# EAGLE board Resistor_Resistor (EAGLE 8.3.0), part 21 of 32
## Placement (x,y rotation side) (continued)
R25476  10K  [0201]  180.19,46.99 0 top
R25477  10K  [0201]  180.19,47.6 0 top
R25478  10K  [0201]  180.19,48.21 0 top
R25479  10K  [0201]  180.19,48.82 0 top
R25480  10K  [0201]  180.19,49.43 0 top
R25481  10K  [0201]  180.19,50.04 0 top
R25482  10K  [0201]  180.19,50.65 0 top
R25483  10K  [0201]  180.19,51.26 0 top
R25484  10K  [0201]  180.19,51.87 0 top
R25485  10K  [0201]  180.19,52.48 0 top
R25486  10K  [0201]  180.19,53.09 0 top
R25487  10K  [0201]  180.19,53.7 0 top
R25488  10K  [0201]  180.19,54.31 0 top
R25489  10K  [0201]  180.19,54.91 0 top
R25490  10K  [0201]  180.19,55.52 0 top
R25491  10K  [0201]  180.19,56.13 0 top
R25492  10K  [0201]  180.19,56.74 0 top
R25493  10K  [0201]  180.19,57.35 0 top
R25494  10K  [0201]  180.19,57.96 0 top
R25495  10K  [0201]  180.19,58.57 0 top
R25496  10K  [0201]  180.19,59.18 0 top
R25497  10K  [0201]  180.19,59.79 0 top
R25498  10K  [0201]  180.19,60.4 0 top
R25499  10K  [0201]  180.19,61.01 0 top
R25500  10K  [0201]  180.19,61.62 0 top
R25501  10K  [0201]  180.19,62.23 0 top
R25502  10K  [0201]  180.19,62.84 0 top
R25503  10K  [0201]  180.19,63.45 0 top
R25504  10K  [0201]  180.19,64.06 0 top
R25505  10K  [0201]  180.19,64.67 0 top
R25506  10K  [0201]  180.19,65.28 0 top
R25507  10K  [0201]  180.19,65.89 0 top
R25508  10K  [0201]  180.19,66.5 0 top
R25509  10K  [0201]  180.19,67.11 0 top
R25510  10K  [0201]  180.19,67.72 0 top
R25511  10K  [0201]  180.19,68.33 0 top
R25512  10K  [0201]  180.19,68.94 0 top
R25513  10K  [0201]  180.19,69.55 0 top
R25514  10K  [0201]  180.19,70.15 0 top
R25515  10K  [0201]  180.19,70.76 0 top
R25516  10K  [0201]  180.19,71.37 0 top
R25517  10K  [0201]  180.19,71.98 0 top
R25518  10K  [0201]  180.19,72.59 0 top
R25519  10K  [0201]  180.19,73.2 0 top
R25520  10K  [0201]  180.19,73.81 0 top
R25521  10K  [0201]  180.19,74.42 0 top
R25522  10K  [0201]  180.19,75.03 0 top
R25523  10K  [0201]  180.19,75.64 0 top
R25524  10K  [0201]  180.19,76.25 0 top
R25525  10K  [0201]  180.19,76.86 0 top
R25526  10K  [0201]  180.19,77.47 0 top
R25527  10K  [0201]  180.19,78.08 0 top
R25528  10K  [0201]  180.19,78.69 0 top
R25529  10K  [0201]  180.19,79.3 0 top
R25530  10K  [0201]  180.19,79.91 0 top
R25531  10K  [0201]  180.19,80.52 0 top
R25532  10K  [0201]  180.19,81.13 0 top
R25533  10K  [0201]  180.19,81.74 0 top
R25534  10K  [0201]  180.19,82.35 0 top
R25535  10K  [0201]  180.19,82.96 0 top
R25536  10K  [0201]  180.19,83.57 0 top
R25537  10K  [0201]  180.19,84.18 0 top
R25538  10K  [0201]  180.19,84.79 0 top
R25539  10K  [0201]  180.19,85.39 0 top
R25540  10K  [0201]  180.19,86 0 top
R25541  10K  [0201]  180.19,86.61 0 top
R25542  10K  [0201]  180.19,87.22 0 top
R25543  10K  [0201]  180.19,87.83 0 top
R25544  10K  [0201]  180.19,88.44 0 top
R25545  10K  [0201]  180.19,89.05 0 top
R25546  10K  [0201]  180.19,89.66 0 top
R25547  10K  [0201]  180.19,90.27 0 top
R25548  10K  [0201]  180.19,90.88 0 top
R25549  10K  [0201]  180.19,91.49 0 top
R25550  10K  [0201]  180.19,92.1 0 top
R25551  10K  [0201]  180.19,92.71 0 top
R25552  10K  [0201]  180.19,93.32 0 top
R25553  10K  [0201]  180.19,93.93 0 top
R25554  10K  [0201]  180.19,94.54 0 top
R25555  10K  [0201]  180.19,95.15 0 top
R25556  10K  [0201]  180.19,95.76 0 top
R25557  10K  [0201]  180.19,96.37 0 top
R25558  10K  [0201]  180.19,96.98 0 top
R25559  10K  [0201]  180.19,97.59 0 top
R25560  10K  [0201]  180.19,98.2 0 top
R25561  10K  [0201]  180.19,98.81 0 top
R25562  10K  [0201]  180.19,99.42 0 top
R25563  10K  [0201]  180.19,100.03 0 top
R25564  10K  [0201]  180.19,100.63 0 top
R25565  10K  [0201]  180.19,101.24 0 top
R25566  10K  [0201]  180.19,101.85 0 top
R25567  10K  [0201]  180.19,102.46 0 top
R25568  10K  [0201]  180.19,103.07 0 top
R25569  10K  [0201]  180.19,103.68 0 top
R25570  10K  [0201]  180.19,104.29 0 top
R25571  10K  [0201]  180.19,104.9 0 top
R25572  10K  [0201]  180.19,105.51 0 top
R25573  10K  [0201]  180.19,106.12 0 top
R25574  10K  [0201]  180.19,106.73 0 top
R25575  10K  [0201]  180.19,107.34 0 top
R25576  10K  [0201]  180.19,107.95 0 top
R25577  10K  [0201]  180.19,108.56 0 top
R25578  10K  [0201]  180.19,109.17 0 top
R25579  10K  [0201]  180.19,109.78 0 top
R25580  10K  [0201]  180.19,110.39 0 top
R25581  10K  [0201]  180.19,111 0 top
R25582  10K  [0201]  180.19,111.61 0 top
R25583  10K  [0201]  180.19,112.22 0 top
R25584  10K  [0201]  180.19,112.83 0 top
R25585  10K  [0201]  180.19,113.44 0 top
R25586  10K  [0201]  180.19,114.05 0 top
R25587  10K  [0201]  180.19,114.66 0 top
R25588  10K  [0201]  180.19,115.27 0 top
R25589  10K  [0201]  180.19,115.87 0 top
R25590  10K  [0201]  180.19,116.48 0 top
R25591  10K  [0201]  180.19,117.09 0 top
R25592  10K  [0201]  180.19,117.7 0 top
R25593  10K  [0201]  180.19,118.31 0 top
R25594  10K  [0201]  180.19,118.92 0 top
R25595  10K  [0201]  180.19,119.53 0 top
R25596  10K  [0201]  180.19,120.14 0 top
R25597  10K  [0201]  180.19,120.75 0 top
R25598  10K  [0201]  180.19,121.36 0 top
R25599  10K  [0201]  180.19,121.97 0 top
R25600  10K  [0201]  180.19,122.58 0 top
R25601  10K  [0201]  181.41,1.27 0 top
R25602  10K  [0201]  181.41,1.88 0 top
R25603  10K  [0201]  181.41,2.49 0 top
R25604  10K  [0201]  181.41,3.1 0 top
R25605  10K  [0201]  181.41,3.71 0 top
R25606  10K  [0201]  181.41,4.32 0 top
R25607  10K  [0201]  181.41,4.93 0 top
R25608  10K  [0201]  181.41,5.54 0 top
R25609  10K  [0201]  181.41,6.15 0 top
R25610  10K  [0201]  181.41,6.76 0 top
R25611  10K  [0201]  181.41,7.37 0 top
R25612  10K  [0201]  181.41,7.98 0 top
R25613  10K  [0201]  181.41,8.59 0 top
R25614  10K  [0201]  181.41,9.19 0 top
R25615  10K  [0201]  181.41,9.8 0 top
R25616  10K  [0201]  181.41,10.41 0 top
R25617  10K  [0201]  181.41,11.02 0 top
R25618  10K  [0201]  181.41,11.63 0 top
R25619  10K  [0201]  181.41,12.24 0 top
R25620  10K  [0201]  181.41,12.85 0 top
R25621  10K  [0201]  181.41,13.46 0 top
R25622  10K  [0201]  181.41,14.07 0 top
R25623  10K  [0201]  181.41,14.68 0 top
R25624  10K  [0201]  181.41,15.29 0 top
R25625  10K  [0201]  181.41,15.9 0 top
R25626  10K  [0201]  181.41,16.51 0 top
R25627  10K  [0201]  181.41,17.12 0 top
R25628  10K  [0201]  181.41,17.73 0 top
R25629  10K  [0201]  181.41,18.34 0 top
R25630  10K  [0201]  181.41,18.95 0 top
R25631  10K  [0201]  181.41,19.56 0 top
R25632  10K  [0201]  181.41,20.17 0 top
R25633  10K  [0201]  181.41,20.78 0 top
R25634  10K  [0201]  181.41,21.39 0 top
R25635  10K  [0201]  181.41,22 0 top
R25636  10K  [0201]  181.41,22.61 0 top
R25637  10K  [0201]  181.41,23.22 0 top
R25638  10K  [0201]  181.41,23.83 0 top
R25639  10K  [0201]  181.41,24.43 0 top
R25640  10K  [0201]  181.41,25.04 0 top
R25641  10K  [0201]  181.41,25.65 0 top
R25642  10K  [0201]  181.41,26.26 0 top
R25643  10K  [0201]  181.41,26.87 0 top
R25644  10K  [0201]  181.41,27.48 0 top
R25645  10K  [0201]  181.41,28.09 0 top
R25646  10K  [0201]  181.41,28.7 0 top
R25647  10K  [0201]  181.41,29.31 0 top
R25648  10K  [0201]  181.41,29.92 0 top
R25649  10K  [0201]  181.41,30.53 0 top
R25650  10K  [0201]  181.41,31.14 0 top
R25651  10K  [0201]  181.41,31.75 0 top
R25652  10K  [0201]  181.41,32.36 0 top
R25653  10K  [0201]  181.41,32.97 0 top
R25654  10K  [0201]  181.41,33.58 0 top
R25655  10K  [0201]  181.41,34.19 0 top
R25656  10K  [0201]  181.41,34.8 0 top
R25657  10K  [0201]  181.41,35.41 0 top
R25658  10K  [0201]  181.41,36.02 0 top
R25659  10K  [0201]  181.41,36.63 0 top
R25660  10K  [0201]  181.41,37.24 0 top
R25661  10K  [0201]  181.41,37.85 0 top
R25662  10K  [0201]  181.41,38.46 0 top
R25663  10K  [0201]  181.41,39.07 0 top
R25664  10K  [0201]  181.41,39.67 0 top
R25665  10K  [0201]  181.41,40.28 0 top
R25666  10K  [0201]  181.41,40.89 0 top
R25667  10K  [0201]  181.41,41.5 0 top
R25668  10K  [0201]  181.41,42.11 0 top
R25669  10K  [0201]  181.41,42.72 0 top
R25670  10K  [0201]  181.41,43.33 0 top
R25671  10K  [0201]  181.41,43.94 0 top
R25672  10K  [0201]  181.41,44.55 0 top
R25673  10K  [0201]  181.41,45.16 0 top
R25674  10K  [0201]  181.41,45.77 0 top
R25675  10K  [0201]  181.41,46.38 0 top
R25676  10K  [0201]  181.41,46.99 0 top
R25677  10K  [0201]  181.41,47.6 0 top
R25678  10K  [0201]  181.41,48.21 0 top
R25679  10K  [0201]  181.41,48.82 0 top
R25680  10K  [0201]  181.41,49.43 0 top
R25681  10K  [0201]  181.41,50.04 0 top
R25682  10K  [0201]  181.41,50.65 0 top
R25683  10K  [0201]  181.41,51.26 0 top
R25684  10K  [0201]  181.41,51.87 0 top
R25685  10K  [0201]  181.41,52.48 0 top
R25686  10K  [0201]  181.41,53.09 0 top
R25687  10K  [0201]  181.41,53.7 0 top
R25688  10K  [0201]  181.41,54.31 0 top
R25689  10K  [0201]  181.41,54.91 0 top
R25690  10K  [0201]  181.41,55.52 0 top
R25691  10K  [0201]  181.41,56.13 0 top
R25692  10K  [0201]  181.41,56.74 0 top
R25693  10K  [0201]  181.41,57.35 0 top
R25694  10K  [0201]  181.41,57.96 0 top
R25695  10K  [0201]  181.41,58.57 0 top
R25696  10K  [0201]  181.41,59.18 0 top
R25697  10K  [0201]  181.41,59.79 0 top
R25698  10K  [0201]  181.41,60.4 0 top
R25699  10K  [0201]  181.41,61.01 0 top
R25700  10K  [0201]  181.41,61.62 0 top
R25701  10K  [0201]  181.41,62.23 0 top
R25702  10K  [0201]  181.41,62.84 0 top
R25703  10K  [0201]  181.41,63.45 0 top
R25704  10K  [0201]  181.41,64.06 0 top
R25705  10K  [0201]  181.41,64.67 0 top
R25706  10K  [0201]  181.41,65.28 0 top
R25707  10K  [0201]  181.41,65.89 0 top
R25708  10K  [0201]  181.41,66.5 0 top
R25709  10K  [0201]  181.41,67.11 0 top
R25710  10K  [0201]  181.41,67.72 0 top
R25711  10K  [0201]  181.41,68.33 0 top
R25712  10K  [0201]  181.41,68.94 0 top
R25713  10K  [0201]  181.41,69.55 0 top
R25714  10K  [0201]  181.41,70.15 0 top
R25715  10K  [0201]  181.41,70.76 0 top
R25716  10K  [0201]  181.41,71.37 0 top
R25717  10K  [0201]  181.41,71.98 0 top
R25718  10K  [0201]  181.41,72.59 0 top
R25719  10K  [0201]  181.41,73.2 0 top
R25720  10K  [0201]  181.41,73.81 0 top
R25721  10K  [0201]  181.41,74.42 0 top
R25722  10K  [0201]  181.41,75.03 0 top
R25723  10K  [0201]  181.41,75.64 0 top
R25724  10K  [0201]  181.41,76.25 0 top
R25725  10K  [0201]  181.41,76.86 0 top
R25726  10K  [0201]  181.41,77.47 0 top
R25727  10K  [0201]  181.41,78.08 0 top
R25728  10K  [0201]  181.41,78.69 0 top
R25729  10K  [0201]  181.41,79.3 0 top
R25730  10K  [0201]  181.41,79.91 0 top
R25731  10K  [0201]  181.41,80.52 0 top
R25732  10K  [0201]  181.41,81.13 0 top
R25733  10K  [0201]  181.41,81.74 0 top
R25734  10K  [0201]  181.41,82.35 0 top
R25735  10K  [0201]  181.41,82.96 0 top
R25736  10K  [0201]  181.41,83.57 0 top
R25737  10K  [0201]  181.41,84.18 0 top
R25738  10K  [0201]  181.41,84.79 0 top
R25739  10K  [0201]  181.41,85.39 0 top
R25740  10K  [0201]  181.41,86 0 top
R25741  10K  [0201]  181.41,86.61 0 top
R25742  10K  [0201]  181.41,87.22 0 top
R25743  10K  [0201]  181.41,87.83 0 top
R25744  10K  [0201]  181.41,88.44 0 top
R25745  10K  [0201]  181.41,89.05 0 top
R25746  10K  [0201]  181.41,89.66 0 top
R25747  10K  [0201]  181.41,90.27 0 top
R25748  10K  [0201]  181.41,90.88 0 top
R25749  10K  [0201]  181.41,91.49 0 top
R25750  10K  [0201]  181.41,92.1 0 top
R25751  10K  [0201]  181.41,92.71 0 top
R25752  10K  [0201]  181.41,93.32 0 top
R25753  10K  [0201]  181.41,93.93 0 top
R25754  10K  [0201]  181.41,94.54 0 top
R25755  10K  [0201]  181.41,95.15 0 top
R25756  10K  [0201]  181.41,95.76 0 top
R25757  10K  [0201]  181.41,96.37 0 top
R25758  10K  [0201]  181.41,96.98 0 top
R25759  10K  [0201]  181.41,97.59 0 top
R25760  10K  [0201]  181.41,98.2 0 top
R25761  10K  [0201]  181.41,98.81 0 top
R25762  10K  [0201]  181.41,99.42 0 top
R25763  10K  [0201]  181.41,100.03 0 top
R25764  10K  [0201]  181.41,100.63 0 top
R25765  10K  [0201]  181.41,101.24 0 top
R25766  10K  [0201]  181.41,101.85 0 top
R25767  10K  [0201]  181.41,102.46 0 top
R25768  10K  [0201]  181.41,103.07 0 top
R25769  10K  [0201]  181.41,103.68 0 top
R25770  10K  [0201]  181.41,104.29 0 top
R25771  10K  [0201]  181.41,104.9 0 top
R25772  10K  [0201]  181.41,105.51 0 top
R25773  10K  [0201]  181.41,106.12 0 top
R25774  10K  [0201]  181.41,106.73 0 top
R25775  10K  [0201]  181.41,107.34 0 top
R25776  10K  [0201]  181.41,107.95 0 top
R25777  10K  [0201]  181.41,108.56 0 top
R25778  10K  [0201]  181.41,109.17 0 top
R25779  10K  [0201]  181.41,109.78 0 top
R25780  10K  [0201]  181.41,110.39 0 top
R25781  10K  [0201]  181.41,111 0 top
R25782  10K  [0201]  181.41,111.61 0 top
R25783  10K  [0201]  181.41,112.22 0 top
R25784  10K  [0201]  181.41,112.83 0 top
R25785  10K  [0201]  181.41,113.44 0 top
R25786  10K  [0201]  181.41,114.05 0 top
R25787  10K  [0201]  181.41,114.66 0 top
R25788  10K  [0201]  181.41,115.27 0 top
R25789  10K  [0201]  181.41,115.87 0 top
R25790  10K  [0201]  181.41,116.48 0 top
R25791  10K  [0201]  181.41,117.09 0 top
R25792  10K  [0201]  181.41,117.7 0 top
R25793  10K  [0201]  181.41,118.31 0 top
R25794  10K  [0201]  181.41,118.92 0 top
R25795  10K  [0201]  181.41,119.53 0 top
R25796  10K  [0201]  181.41,120.14 0 top
R25797  10K  [0201]  181.41,120.75 0 top
R25798  10K  [0201]  181.41,121.36 0 top
R25799  10K  [0201]  181.41,121.97 0 top
R25800  10K  [0201]  181.41,122.58 0 top
R25801  10K  [0201]  182.63,1.27 0 top
R25802  10K  [0201]  182.63,1.88 0 top
R25803  10K  [0201]  182.63,2.49 0 top
R25804  10K  [0201]  182.63,3.1 0 top
R25805  10K  [0201]  182.63,3.71 0 top
R25806  10K  [0201]  182.63,4.32 0 top
R25807  10K  [0201]  182.63,4.93 0 top
R25808  10K  [0201]  182.63,5.54 0 top
R25809  10K  [0201]  182.63,6.15 0 top
R25810  10K  [0201]  182.63,6.76 0 top
R25811  10K  [0201]  182.63,7.37 0 top
R25812  10K  [0201]  182.63,7.98 0 top
R25813  10K  [0201]  182.63,8.59 0 top
R25814  10K  [0201]  182.63,9.19 0 top
R25815  10K  [0201]  182.63,9.8 0 top
R25816  10K  [0201]  182.63,10.41 0 top
R25817  10K  [0201]  182.63,11.02 0 top
R25818  10K  [0201]  182.63,11.63 0 top
R25819  10K  [0201]  182.63,12.24 0 top
R25820  10K  [0201]  182.63,12.85 0 top
R25821  10K  [0201]  182.63,13.46 0 top
R25822  10K  [0201]  182.63,14.07 0 top
R25823  10K  [0201]  182.63,14.68 0 top
R25824  10K  [0201]  182.63,15.29 0 top
R25825  10K  [0201]  182.63,15.9 0 top
R25826  10K  [0201]  182.63,16.51 0 top
R25827  10K  [0201]  182.63,17.12 0 top
R25828  10K  [0201]  182.63,17.73 0 top
R25829  10K  [0201]  182.63,18.34 0 top
R25830  10K  [0201]  182.63,18.95 0 top
R25831  10K  [0201]  182.63,19.56 0 top
R25832  10K  [0201]  182.63,20.17 0 top
R25833  10K  [0201]  182.63,20.78 0 top
R25834  10K  [0201]  182.63,21.39 0 top
R25835  10K  [0201]  182.63,22 0 top
R25836  10K  [0201]  182.63,22.61 0 top
R25837  10K  [0201]  182.63,23.22 0 top
R25838  10K  [0201]  182.63,23.83 0 top
R25839  10K  [0201]  182.63,24.43 0 top
R25840  10K  [0201]  182.63,25.04 0 top
R25841  10K  [0201]  182.63,25.65 0 top
R25842  10K  [0201]  182.63,26.26 0 top
R25843  10K  [0201]  182.63,26.87 0 top
R25844  10K  [0201]  182.63,27.48 0 top
R25845  10K  [0201]  182.63,28.09 0 top
R25846  10K  [0201]  182.63,28.7 0 top
R25847  10K  [0201]  182.63,29.31 0 top
R25848  10K  [0201]  182.63,29.92 0 top
R25849  10K  [0201]  182.63,30.53 0 top
R25850  10K  [0201]  182.63,31.14 0 top
R25851  10K  [0201]  182.63,31.75 0 top
R25852  10K  [0201]  182.63,32.36 0 top
R25853  10K  [0201]  182.63,32.97 0 top
R25854  10K  [0201]  182.63,33.58 0 top
R25855  10K  [0201]  182.63,34.19 0 top
R25856  10K  [0201]  182.63,34.8 0 top
R25857  10K  [0201]  182.63,35.41 0 top
R25858  10K  [0201]  182.63,36.02 0 top
R25859  10K  [0201]  182.63,36.63 0 top
R25860  10K  [0201]  182.63,37.24 0 top
R25861  10K  [0201]  182.63,37.85 0 top
R25862  10K  [0201]  182.63,38.46 0 top
R25863  10K  [0201]  182.63,39.07 0 top
R25864  10K  [0201]  182.63,39.67 0 top
R25865  10K  [0201]  182.63,40.28 0 top
R25866  10K  [0201]  182.63,40.89 0 top
R25867  10K  [0201]  182.63,41.5 0 top
R25868  10K  [0201]  182.63,42.11 0 top
R25869  10K  [0201]  182.63,42.72 0 top
R25870  10K  [0201]  182.63,43.33 0 top
R25871  10K  [0201]  182.63,43.94 0 top
R25872  10K  [0201]  182.63,44.55 0 top
R25873  10K  [0201]  182.63,45.16 0 top
R25874  10K  [0201]  182.63,45.77 0 top
R25875  10K  [0201]  182.63,46.38 0 top
R25876  10K  [0201]  182.63,46.99 0 top
R25877  10K  [0201]  182.63,47.6 0 top
R25878  10K  [0201]  182.63,48.21 0 top
R25879  10K  [0201]  182.63,48.82 0 top
R25880  10K  [0201]  182.63,49.43 0 top
R25881  10K  [0201]  182.63,50.04 0 top
R25882  10K  [0201]  182.63,50.65 0 top
R25883  10K  [0201]  182.63,51.26 0 top
R25884  10K  [0201]  182.63,51.87 0 top
R25885  10K  [0201]  182.63,52.48 0 top
R25886  10K  [0201]  182.63,53.09 0 top
R25887  10K  [0201]  182.63,53.7 0 top
R25888  10K  [0201]  182.63,54.31 0 top
R25889  10K  [0201]  182.63,54.91 0 top
R25890  10K  [0201]  182.63,55.52 0 top
R25891  10K  [0201]  182.63,56.13 0 top
R25892  10K  [0201]  182.63,56.74 0 top
R25893  10K  [0201]  182.63,57.35 0 top
R25894  10K  [0201]  182.63,57.96 0 top
R25895  10K  [0201]  182.63,58.57 0 top
R25896  10K  [0201]  182.63,59.18 0 top
R25897  10K  [0201]  182.63,59.79 0 top
R25898  10K  [0201]  182.63,60.4 0 top
R25899  10K  [0201]  182.63,61.01 0 top
R25900  10K  [0201]  182.63,61.62 0 top
R25901  10K  [0201]  182.63,62.23 0 top
R25902  10K  [0201]  182.63,62.84 0 top
R25903  10K  [0201]  182.63,63.45 0 top
R25904  10K  [0201]  182.63,64.06 0 top
R25905  10K  [0201]  182.63,64.67 0 top
R25906  10K  [0201]  182.63,65.28 0 top
R25907  10K  [0201]  182.63,65.89 0 top
R25908  10K  [0201]  182.63,66.5 0 top
R25909  10K  [0201]  182.63,67.11 0 top
R25910  10K  [0201]  182.63,67.72 0 top
R25911  10K  [0201]  182.63,68.33 0 top
R25912  10K  [0201]  182.63,68.94 0 top
R25913  10K  [0201]  182.63,69.55 0 top
R25914  10K  [0201]  182.63,70.15 0 top
R25915  10K  [0201]  182.63,70.76 0 top
R25916  10K  [0201]  182.63,71.37 0 top
R25917  10K  [0201]  182.63,71.98 0 top
R25918  10K  [0201]  182.63,72.59 0 top
R25919  10K  [0201]  182.63,73.2 0 top
R25920  10K  [0201]  182.63,73.81 0 top
R25921  10K  [0201]  182.63,74.42 0 top
R25922  10K  [0201]  182.63,75.03 0 top
R25923  10K  [0201]  182.63,75.64 0 top
R25924  10K  [0201]  182.63,76.25 0 top
R25925  10K  [0201]  182.63,76.86 0 top
R25926  10K  [0201]  182.63,77.47 0 top
R25927  10K  [0201]  182.63,78.08 0 top
R25928  10K  [0201]  182.63,78.69 0 top
R25929  10K  [0201]  182.63,79.3 0 top
R25930  10K  [0201]  182.63,79.91 0 top
R25931  10K  [0201]  182.63,80.52 0 top
R25932  10K  [0201]  182.63,81.13 0 top
R25933  10K  [0201]  182.63,81.74 0 top
R25934  10K  [0201]  182.63,82.35 0 top
R25935  10K  [0201]  182.63,82.96 0 top
R25936  10K  [0201]  182.63,83.57 0 top
R25937  10K  [0201]  182.63,84.18 0 top
R25938  10K  [0201]  182.63,84.79 0 top
R25939  10K  [0201]  182.63,85.39 0 top
R25940  10K  [0201]  182.63,86 0 top
R25941  10K  [0201]  182.63,86.61 0 top
R25942  10K  [0201]  182.63,87.22 0 top
R25943  10K  [0201]  182.63,87.83 0 top
R25944  10K  [0201]  182.63,88.44 0 top
R25945  10K  [0201]  182.63,89.05 0 top
R25946  10K  [0201]  182.63,89.66 0 top
R25947  10K  [0201]  182.63,90.27 0 top
R25948  10K  [0201]  182.63,90.88 0 top
R25949  10K  [0201]  182.63,91.49 0 top
R25950  10K  [0201]  182.63,92.1 0 top
R25951  10K  [0201]  182.63,92.71 0 top
R25952  10K  [0201]  182.63,93.32 0 top
R25953  10K  [0201]  182.63,93.93 0 top
R25954  10K  [0201]  182.63,94.54 0 top
R25955  10K  [0201]  182.63,95.15 0 top
R25956  10K  [0201]  182.63,95.76 0 top
R25957  10K  [0201]  182.63,96.37 0 top
R25958  10K  [0201]  182.63,96.98 0 top
R25959  10K  [0201]  182.63,97.59 0 top
R25960  10K  [0201]  182.63,98.2 0 top
R25961  10K  [0201]  182.63,98.81 0 top
R25962  10K  [0201]  182.63,99.42 0 top
R25963  10K  [0201]  182.63,100.03 0 top
R25964  10K  [0201]  182.63,100.63 0 top
R25965  10K  [0201]  182.63,101.24 0 top
R25966  10K  [0201]  182.63,101.85 0 top
R25967  10K  [0201]  182.63,102.46 0 top
R25968  10K  [0201]  182.63,103.07 0 top
R25969  10K  [0201]  182.63,103.68 0 top
R25970  10K  [0201]  182.63,104.29 0 top
R25971  10K  [0201]  182.63,104.9 0 top
R25972  10K  [0201]  182.63,105.51 0 top
R25973  10K  [0201]  182.63,106.12 0 top
R25974  10K  [0201]  182.63,106.73 0 top
R25975  10K  [0201]  182.63,107.34 0 top
R25976  10K  [0201]  182.63,107.95 0 top
R25977  10K  [0201]  182.63,108.56 0 top
R25978  10K  [0201]  182.63,109.17 0 top
R25979  10K  [0201]  182.63,109.78 0 top
R25980  10K  [0201]  182.63,110.39 0 top
R25981  10K  [0201]  182.63,111 0 top
R25982  10K  [0201]  182.63,111.61 0 top
R25983  10K  [0201]  182.63,112.22 0 top
R25984  10K  [0201]  182.63,112.83 0 top
R25985  10K  [0201]  182.63,113.44 0 top
R25986  10K  [0201]  182.63,114.05 0 top
R25987  10K  [0201]  182.63,114.66 0 top
R25988  10K  [0201]  182.63,115.27 0 top
R25989  10K  [0201]  182.63,115.87 0 top
R25990  10K  [0201]  182.63,116.48 0 top
R25991  10K  [0201]  182.63,117.09 0 top
R25992  10K  [0201]  182.63,117.7 0 top
R25993  10K  [0201]  182.63,118.31 0 top
R25994  10K  [0201]  182.63,118.92 0 top
R25995  10K  [0201]  182.63,119.53 0 top
R25996  10K  [0201]  182.63,120.14 0 top
R25997  10K  [0201]  182.63,120.75 0 top
R25998  10K  [0201]  182.63,121.36 0 top
R25999  10K  [0201]  182.63,121.97 0 top
R26000  10K  [0201]  182.63,122.58 0 top
R26001  10K  [0201]  183.85,1.27 0 top
R26002  10K  [0201]  183.85,1.88 0 top
R26003  10K  [0201]  183.85,2.49 0 top
R26004  10K  [0201]  183.85,3.1 0 top
R26005  10K  [0201]  183.85,3.71 0 top
R26006  10K  [0201]  183.85,4.32 0 top
R26007  10K  [0201]  183.85,4.93 0 top
R26008  10K  [0201]  183.85,5.54 0 top
R26009  10K  [0201]  183.85,6.15 0 top
R26010  10K  [0201]  183.85,6.76 0 top
R26011  10K  [0201]  183.85,7.37 0 top
R26012  10K  [0201]  183.85,7.98 0 top
R26013  10K  [0201]  183.85,8.59 0 top
R26014  10K  [0201]  183.85,9.19 0 top
R26015  10K  [0201]  183.85,9.8 0 top
R26016  10K  [0201]  183.85,10.41 0 top
R26017  10K  [0201]  183.85,11.02 0 top
R26018  10K  [0201]  183.85,11.63 0 top
R26019  10K  [0201]  183.85,12.24 0 top
R26020  10K  [0201]  183.85,12.85 0 top
R26021  10K  [0201]  183.85,13.46 0 top
R26022  10K  [0201]  183.85,14.07 0 top
R26023  10K  [0201]  183.85,14.68 0 top
R26024  10K  [0201]  183.85,15.29 0 top
R26025  10K  [0201]  183.85,15.9 0 top
R26026  10K  [0201]  183.85,16.51 0 top
R26027  10K  [0201]  183.85,17.12 0 top
R26028  10K  [0201]  183.85,17.73 0 top
R26029  10K  [0201]  183.85,18.34 0 top
R26030  10K  [0201]  183.85,18.95 0 top
R26031  10K  [0201]  183.85,19.56 0 top
R26032  10K  [0201]  183.85,20.17 0 top
R26033  10K  [0201]  183.85,20.78 0 top
R26034  10K  [0201]  183.85,21.39 0 top
R26035  10K  [0201]  183.85,22 0 top
R26036  10K  [0201]  183.85,22.61 0 top
R26037  10K  [0201]  183.85,23.22 0 top
R26038  10K  [0201]  183.85,23.83 0 top
R26039  10K  [0201]  183.85,24.43 0 top
R26040  10K  [0201]  183.85,25.04 0 top
R26041  10K  [0201]  183.85,25.65 0 top
R26042  10K  [0201]  183.85,26.26 0 top
R26043  10K  [0201]  183.85,26.87 0 top
R26044  10K  [0201]  183.85,27.48 0 top
R26045  10K  [0201]  183.85,28.09 0 top
R26046  10K  [0201]  183.85,28.7 0 top
R26047  10K  [0201]  183.85,29.31 0 top
R26048  10K  [0201]  183.85,29.92 0 top
R26049  10K  [0201]  183.85,30.53 0 top
R26050  10K  [0201]  183.85,31.14 0 top
R26051  10K  [0201]  183.85,31.75 0 top
R26052  10K  [0201]  183.85,32.36 0 top
R26053  10K  [0201]  183.85,32.97 0 top
R26054  10K  [0201]  183.85,33.58 0 top
R26055  10K  [0201]  183.85,34.19 0 top
R26056  10K  [0201]  183.85,34.8 0 top
R26057  10K  [0201]  183.85,35.41 0 top
R26058  10K  [0201]  183.85,36.02 0 top
R26059  10K  [0201]  183.85,36.63 0 top
R26060  10K  [0201]  183.85,37.24 0 top
R26061  10K  [0201]  183.85,37.85 0 top
R26062  10K  [0201]  183.85,38.46 0 top
R26063  10K  [0201]  183.85,39.07 0 top
R26064  10K  [0201]  183.85,39.67 0 top
R26065  10K  [0201]  183.85,40.28 0 top
R26066  10K  [0201]  183.85,40.89 0 top
R26067  10K  [0201]  183.85,41.5 0 top
R26068  10K  [0201]  183.85,42.11 0 top
R26069  10K  [0201]  183.85,42.72 0 top
R26070  10K  [0201]  183.85,43.33 0 top
R26071  10K  [0201]  183.85,43.94 0 top
R26072  10K  [0201]  183.85,44.55 0 top
R26073  10K  [0201]  183.85,45.16 0 top
R26074  10K  [0201]  183.85,45.77 0 top
R26075  10K  [0201]  183.85,46.38 0 top
R26076  10K  [0201]  183.85,46.99 0 top
R26077  10K  [0201]  183.85,47.6 0 top
R26078  10K  [0201]  183.85,48.21 0 top
R26079  10K  [0201]  183.85,48.82 0 top
R26080  10K  [0201]  183.85,49.43 0 top
R26081  10K  [0201]  183.85,50.04 0 top
R26082  10K  [0201]  183.85,50.65 0 top
R26083  10K  [0201]  183.85,51.26 0 top
R26084  10K  [0201]  183.85,51.87 0 top
R26085  10K  [0201]  183.85,52.48 0 top
R26086  10K  [0201]  183.85,53.09 0 top
R26087  10K  [0201]  183.85,53.7 0 top
R26088  10K  [0201]  183.85,54.31 0 top
R26089  10K  [0201]  183.85,54.91 0 top
R26090  10K  [0201]  183.85,55.52 0 top
R26091  10K  [0201]  183.85,56.13 0 top
R26092  10K  [0201]  183.85,56.74 0 top
R26093  10K  [0201]  183.85,57.35 0 top
R26094  10K  [0201]  183.85,57.96 0 top
R26095  10K  [0201]  183.85,58.57 0 top
R26096  10K  [0201]  183.85,59.18 0 top
R26097  10K  [0201]  183.85,59.79 0 top
R26098  10K  [0201]  183.85,60.4 0 top
R26099  10K  [0201]  183.85,61.01 0 top
R26100  10K  [0201]  183.85,61.62 0 top
R26101  10K  [0201]  183.85,62.23 0 top
R26102  10K  [0201]  183.85,62.84 0 top
R26103  10K  [0201]  183.85,63.45 0 top
R26104  10K  [0201]  183.85,64.06 0 top
R26105  10K  [0201]  183.85,64.67 0 top
R26106  10K  [0201]  183.85,65.28 0 top
R26107  10K  [0201]  183.85,65.89 0 top
R26108  10K  [0201]  183.85,66.5 0 top
R26109  10K  [0201]  183.85,67.11 0 top
R26110  10K  [0201]  183.85,67.72 0 top
R26111  10K  [0201]  183.85,68.33 0 top
R26112  10K  [0201]  183.85,68.94 0 top
R26113  10K  [0201]  183.85,69.55 0 top
R26114  10K  [0201]  183.85,70.15 0 top
R26115  10K  [0201]  183.85,70.76 0 top
R26116  10K  [0201]  183.85,71.37 0 top
R26117  10K  [0201]  183.85,71.98 0 top
R26118  10K  [0201]  183.85,72.59 0 top
R26119  10K  [0201]  183.85,73.2 0 top
R26120  10K  [0201]  183.85,73.81 0 top
R26121  10K  [0201]  183.85,74.42 0 top
R26122  10K  [0201]  183.85,75.03 0 top
R26123  10K  [0201]  183.85,75.64 0 top
R26124  10K  [0201]  183.85,76.25 0 top
R26125  10K  [0201]  183.85,76.86 0 top
R26126  10K  [0201]  183.85,77.47 0 top
R26127  10K  [0201]  183.85,78.08 0 top
R26128  10K  [0201]  183.85,78.69 0 top
R26129  10K  [0201]  183.85,79.3 0 top
R26130  10K  [0201]  183.85,79.91 0 top
R26131  10K  [0201]  183.85,80.52 0 top
R26132  10K  [0201]  183.85,81.13 0 top
R26133  10K  [0201]  183.85,81.74 0 top
R26134  10K  [0201]  183.85,82.35 0 top
R26135  10K  [0201]  183.85,82.96 0 top
R26136  10K  [0201]  183.85,83.57 0 top
R26137  10K  [0201]  183.85,84.18 0 top
R26138  10K  [0201]  183.85,84.79 0 top
R26139  10K  [0201]  183.85,85.39 0 top
R26140  10K  [0201]  183.85,86 0 top
R26141  10K  [0201]  183.85,86.61 0 top
R26142  10K  [0201]  183.85,87.22 0 top
R26143  10K  [0201]  183.85,87.83 0 top
R26144  10K  [0201]  183.85,88.44 0 top
R26145  10K  [0201]  183.85,89.05 0 top
R26146  10K  [0201]  183.85,89.66 0 top
R26147  10K  [0201]  183.85,90.27 0 top
R26148  10K  [0201]  183.85,90.88 0 top
R26149  10K  [0201]  183.85,91.49 0 top
R26150  10K  [0201]  183.85,92.1 0 top
R26151  10K  [0201]  183.85,92.71 0 top
R26152  10K  [0201]  183.85,93.32 0 top
R26153  10K  [0201]  183.85,93.93 0 top
R26154  10K  [0201]  183.85,94.54 0 top
R26155  10K  [0201]  183.85,95.15 0 top
R26156  10K  [0201]  183.85,95.76 0 top
R26157  10K  [0201]  183.85,96.37 0 top
R26158  10K  [0201]  183.85,96.98 0 top
R26159  10K  [0201]  183.85,97.59 0 top
R26160  10K  [0201]  183.85,98.2 0 top
R26161  10K  [0201]  183.85,98.81 0 top
R26162  10K  [0201]  183.85,99.42 0 top
R26163  10K  [0201]  183.85,100.03 0 top
R26164  10K  [0201]  183.85,100.63 0 top
R26165  10K  [0201]  183.85,101.24 0 top
R26166  10K  [0201]  183.85,101.85 0 top
R26167  10K  [0201]  183.85,102.46 0 top
R26168  10K  [0201]  183.85,103.07 0 top
R26169  10K  [0201]  183.85,103.68 0 top
R26170  10K  [0201]  183.85,104.29 0 top
R26171  10K  [0201]  183.85,104.9 0 top
R26172  10K  [0201]  183.85,105.51 0 top
R26173  10K  [0201]  183.85,106.12 0 top
R26174  10K  [0201]  183.85,106.73 0 top
R26175  10K  [0201]  183.85,107.34 0 top
R26176  10K  [0201]  183.85,107.95 0 top
R26177  10K  [0201]  183.85,108.56 0 top
R26178  10K  [0201]  183.85,109.17 0 top
R26179  10K  [0201]  183.85,109.78 0 top
R26180  10K  [0201]  183.85,110.39 0 top
R26181  10K  [0201]  183.85,111 0 top
R26182  10K  [0201]  183.85,111.61 0 top
R26183  10K  [0201]  183.85,112.22 0 top
R26184  10K  [0201]  183.85,112.83 0 top
R26185  10K  [0201]  183.85,113.44 0 top
R26186  10K  [0201]  183.85,114.05 0 top
R26187  10K  [0201]  183.85,114.66 0 top
R26188  10K  [0201]  183.85,115.27 0 top
R26189  10K  [0201]  183.85,115.87 0 top
R26190  10K  [0201]  183.85,116.48 0 top
R26191  10K  [0201]  183.85,117.09 0 top
R26192  10K  [0201]  183.85,117.7 0 top
R26193  10K  [0201]  183.85,118.31 0 top
R26194  10K  [0201]  183.85,118.92 0 top
R26195  10K  [0201]  183.85,119.53 0 top
R26196  10K  [0201]  183.85,120.14 0 top
R26197  10K  [0201]  183.85,120.75 0 top
R26198  10K  [0201]  183.85,121.36 0 top
R26199  10K  [0201]  183.85,121.97 0 top
R26200  10K  [0201]  183.85,122.58 0 top
R26201  10K  [0201]  185.06,1.27 0 top
R26202  10K  [0201]  185.06,1.88 0 top
R26203  10K  [0201]  185.06,2.49 0 top
R26204  10K  [0201]  185.06,3.1 0 top
R26205  10K  [0201]  185.06,3.71 0 top
R26206  10K  [0201]  185.06,4.32 0 top
R26207  10K  [0201]  185.06,4.93 0 top
R26208  10K  [0201]  185.06,5.54 0 top
R26209  10K  [0201]  185.06,6.15 0 top
R26210  10K  [0201]  185.06,6.76 0 top
R26211  10K  [0201]  185.06,7.37 0 top
R26212  10K  [0201]  185.06,7.98 0 top
R26213  10K  [0201]  185.06,8.59 0 top
R26214  10K  [0201]  185.06,9.19 0 top
R26215  10K  [0201]  185.06,9.8 0 top
R26216  10K  [0201]  185.06,10.41 0 top
R26217  10K  [0201]  185.06,11.02 0 top
R26218  10K  [0201]  185.06,11.63 0 top
R26219  10K  [0201]  185.06,12.24 0 top
R26220  10K  [0201]  185.06,12.85 0 top
R26221  10K  [0201]  185.06,13.46 0 top
R26222  10K  [0201]  185.06,14.07 0 top
R26223  10K  [0201]  185.06,14.68 0 top
R26224  10K  [0201]  185.06,15.29 0 top
R26225  10K  [0201]  185.06,15.9 0 top
R26226  10K  [0201]  185.06,16.51 0 top
R26227  10K  [0201]  185.06,17.12 0 top
R26228  10K  [0201]  185.06,17.73 0 top
R26229  10K  [0201]  185.06,18.34 0 top
R26230  10K  [0201]  185.06,18.95 0 top
R26231  10K  [0201]  185.06,19.56 0 top
R26232  10K  [0201]  185.06,20.17 0 top
R26233  10K  [0201]  185.06,20.78 0 top
R26234  10K  [0201]  185.06,21.39 0 top
R26235  10K  [0201]  185.06,22 0 top
R26236  10K  [0201]  185.06,22.61 0 top
R26237  10K  [0201]  185.06,23.22 0 top
R26238  10K  [0201]  185.06,23.83 0 top
R26239  10K  [0201]  185.06,24.43 0 top
R26240  10K  [0201]  185.06,25.04 0 top
R26241  10K  [0201]  185.06,25.65 0 top
R26242  10K  [0201]  185.06,26.26 0 top
R26243  10K  [0201]  185.06,26.87 0 top
R26244  10K  [0201]  185.06,27.48 0 top
R26245  10K  [0201]  185.06,28.09 0 top
R26246  10K  [0201]  185.06,28.7 0 top
R26247  10K  [0201]  185.06,29.31 0 top
R26248  10K  [0201]  185.06,29.92 0 top
R26249  10K  [0201]  185.06,30.53 0 top
R26250  10K  [0201]  185.06,31.14 0 top
R26251  10K  [0201]  185.06,31.75 0 top
R26252  10K  [0201]  185.06,32.36 0 top
R26253  10K  [0201]  185.06,32.97 0 top
R26254  10K  [0201]  185.06,33.58 0 top
R26255  10K  [0201]  185.06,34.19 0 top
R26256  10K  [0201]  185.06,34.8 0 top
R26257  10K  [0201]  185.06,35.41 0 top
R26258  10K  [0201]  185.06,36.02 0 top
R26259  10K  [0201]  185.06,36.63 0 top
R26260  10K  [0201]  185.06,37.24 0 top
R26261  10K  [0201]  185.06,37.85 0 top
R26262  10K  [0201]  185.06,38.46 0 top
R26263  10K  [0201]  185.06,39.07 0 top
R26264  10K  [0201]  185.06,39.67 0 top
R26265  10K  [0201]  185.06,40.28 0 top
R26266  10K  [0201]  185.06,40.89 0 top
R26267  10K  [0201]  185.06,41.5 0 top
R26268  10K  [0201]  185.06,42.11 0 top
R26269  10K  [0201]  185.06,42.72 0 top
R26270  10K  [0201]  185.06,43.33 0 top
R26271  10K  [0201]  185.06,43.94 0 top
R26272  10K  [0201]  185.06,44.55 0 top
R26273  10K  [0201]  185.06,45.16 0 top
R26274  10K  [0201]  185.06,45.77 0 top
R26275  10K  [0201]  185.06,46.38 0 top
R26276  10K  [0201]  185.06,46.99 0 top
R26277  10K  [0201]  185.06,47.6 0 top
R26278  10K  [0201]  185.06,48.21 0 top
R26279  10K  [0201]  185.06,48.82 0 top
R26280  10K  [0201]  185.06,49.43 0 top
R26281  10K  [0201]  185.06,50.04 0 top
R26282  10K  [0201]  185.06,50.65 0 top
R26283  10K  [0201]  185.06,51.26 0 top
R26284  10K  [0201]  185.06,51.87 0 top
R26285  10K  [0201]  185.06,52.48 0 top
R26286  10K  [0201]  185.06,53.09 0 top
R26287  10K  [0201]  185.06,53.7 0 top
R26288  10K  [0201]  185.06,54.31 0 top
R26289  10K  [0201]  185.06,54.91 0 top
R26290  10K  [0201]  185.06,55.52 0 top
R26291  10K  [0201]  185.06,56.13 0 top
R26292  10K  [0201]  185.06,56.74 0 top
R26293  10K  [0201]  185.06,57.35 0 top
R26294  10K  [0201]  185.06,57.96 0 top
R26295  10K  [0201]  185.06,58.57 0 top
R26296  10K  [0201]  185.06,59.18 0 top
R26297  10K  [0201]  185.06,59.79 0 top
R26298  10K  [0201]  185.06,60.4 0 top
R26299  10K  [0201]  185.06,61.01 0 top
R26300  10K  [0201]  185.06,61.62 0 top
R26301  10K  [0201]  185.06,62.23 0 top
R26302  10K  [0201]  185.06,62.84 0 top
R26303  10K  [0201]  185.06,63.45 0 top
R26304  10K  [0201]  185.06,64.06 0 top
R26305  10K  [0201]  185.06,64.67 0 top
R26306  10K  [0201]  185.06,65.28 0 top
R26307  10K  [0201]  185.06,65.89 0 top
R26308  10K  [0201]  185.06,66.5 0 top
R26309  10K  [0201]  185.06,67.11 0 top
R26310  10K  [0201]  185.06,67.72 0 top
R26311  10K  [0201]  185.06,68.33 0 top
R26312  10K  [0201]  185.06,68.94 0 top
R26313  10K  [0201]  185.06,69.55 0 top
R26314  10K  [0201]  185.06,70.15 0 top
R26315  10K  [0201]  185.06,70.76 0 top
R26316  10K  [0201]  185.06,71.37 0 top
R26317  10K  [0201]  185.06,71.98 0 top
R26318  10K  [0201]  185.06,72.59 0 top
R26319  10K  [0201]  185.06,73.2 0 top
R26320  10K  [0201]  185.06,73.81 0 top
R26321  10K  [0201]  185.06,74.42 0 top
R26322  10K  [0201]  185.06,75.03 0 top
R26323  10K  [0201]  185.06,75.64 0 top
R26324  10K  [0201]  185.06,76.25 0 top
R26325  10K  [0201]  185.06,76.86 0 top
R26326  10K  [0201]  185.06,77.47 0 top
R26327  10K  [0201]  185.06,78.08 0 top
R26328  10K  [0201]  185.06,78.69 0 top
R26329  10K  [0201]  185.06,79.3 0 top
R26330  10K  [0201]  185.06,79.91 0 top
R26331  10K  [0201]  185.06,80.52 0 top
R26332  10K  [0201]  185.06,81.13 0 top
R26333  10K  [0201]  185.06,81.74 0 top
R26334  10K  [0201]  185.06,82.35 0 top
R26335  10K  [0201]  185.06,82.96 0 top
R26336  10K  [0201]  185.06,83.57 0 top
R26337  10K  [0201]  185.06,84.18 0 top
R26338  10K  [0201]  185.06,84.79 0 top
R26339  10K  [0201]  185.06,85.39 0 top
R26340  10K  [0201]  185.06,86 0 top
R26341  10K  [0201]  185.06,86.61 0 top
R26342  10K  [0201]  185.06,87.22 0 top
R26343  10K  [0201]  185.06,87.83 0 top
R26344  10K  [0201]  185.06,88.44 0 top
R26345  10K  [0201]  185.06,89.05 0 top
R26346  10K  [0201]  185.06,89.66 0 top
R26347  10K  [0201]  185.06,90.27 0 top
R26348  10K  [0201]  185.06,90.88 0 top
R26349  10K  [0201]  185.06,91.49 0 top
R26350  10K  [0201]  185.06,92.1 0 top
R26351  10K  [0201]  185.06,92.71 0 top
R26352  10K  [0201]  185.06,93.32 0 top
R26353  10K  [0201]  185.06,93.93 0 top
R26354  10K  [0201]  185.06,94.54 0 top
R26355  10K  [0201]  185.06,95.15 0 top
R26356  10K  [0201]  185.06,95.76 0 top
R26357  10K  [0201]  185.06,96.37 0 top
R26358  10K  [0201]  185.06,96.98 0 top
R26359  10K  [0201]  185.06,97.59 0 top
R26360  10K  [0201]  185.06,98.2 0 top
R26361  10K  [0201]  185.06,98.81 0 top
R26362  10K  [0201]  185.06,99.42 0 top
R26363  10K  [0201]  185.06,100.03 0 top
R26364  10K  [0201]  185.06,100.63 0 top
R26365  10K  [0201]  185.06,101.24 0 top
R26366  10K  [0201]  185.06,101.85 0 top
R26367  10K  [0201]  185.06,102.46 0 top
R26368  10K  [0201]  185.06,103.07 0 top
R26369  10K  [0201]  185.06,103.68 0 top
R26370  10K  [0201]  185.06,104.29 0 top
R26371  10K  [0201]  185.06,104.9 0 top
R26372  10K  [0201]  185.06,105.51 0 top
R26373  10K  [0201]  185.06,106.12 0 top
R26374  10K  [0201]  185.06,106.73 0 top
R26375  10K  [0201]  185.06,107.34 0 top
R26376  10K  [0201]  185.06,107.95 0 top
R26377  10K  [0201]  185.06,108.56 0 top
R26378  10K  [0201]  185.06,109.17 0 top
R26379  10K  [0201]  185.06,109.78 0 top
R26380  10K  [0201]  185.06,110.39 0 top
R26381  10K  [0201]  185.06,111 0 top
R26382  10K  [0201]  185.06,111.61 0 top
R26383  10K  [0201]  185.06,112.22 0 top
R26384  10K  [0201]  185.06,112.83 0 top
R26385  10K  [0201]  185.06,113.44 0 top
R26386  10K  [0201]  185.06,114.05 0 top
R26387  10K  [0201]  185.06,114.66 0 top
R26388  10K  [0201]  185.06,115.27 0 top
R26389  10K  [0201]  185.06,115.87 0 top
R26390  10K  [0201]  185.06,116.48 0 top
R26391  10K  [0201]  185.06,117.09 0 top
R26392  10K  [0201]  185.06,117.7 0 top
R26393  10K  [0201]  185.06,118.31 0 top
R26394  10K  [0201]  185.06,118.92 0 top
R26395  10K  [0201]  185.06,119.53 0 top
R26396  10K  [0201]  185.06,120.14 0 top
R26397  10K  [0201]  185.06,120.75 0 top
R26398  10K  [0201]  185.06,121.36 0 top
R26399  10K  [0201]  185.06,121.97 0 top
R26400  10K  [0201]  185.06,122.58 0 top
R26401  10K  [0201]  186.28,1.27 0 top
R26402  10K  [0201]  186.28,1.88 0 top
R26403  10K  [0201]  186.28,2.49 0 top
R26404  10K  [0201]  186.28,3.1 0 top
R26405  10K  [0201]  186.28,3.71 0 top
R26406  10K  [0201]  186.28,4.32 0 top
R26407  10K  [0201]  186.28,4.93 0 top
R26408  10K  [0201]  186.28,5.54 0 top
R26409  10K  [0201]  186.28,6.15 0 top
R26410  10K  [0201]  186.28,6.76 0 top
R26411  10K  [0201]  186.28,7.37 0 top
R26412  10K  [0201]  186.28,7.98 0 top
R26413  10K  [0201]  186.28,8.59 0 top
R26414  10K  [0201]  186.28,9.19 0 top
R26415  10K  [0201]  186.28,9.8 0 top
R26416  10K  [0201]  186.28,10.41 0 top
R26417  10K  [0201]  186.28,11.02 0 top
R26418  10K  [0201]  186.28,11.63 0 top
R26419  10K  [0201]  186.28,12.24 0 top
R26420  10K  [0201]  186.28,12.85 0 top
R26421  10K  [0201]  186.28,13.46 0 top
R26422  10K  [0201]  186.28,14.07 0 top
R26423  10K  [0201]  186.28,14.68 0 top
R26424  10K  [0201]  186.28,15.29 0 top
R26425  10K  [0201]  186.28,15.9 0 top
R26426  10K  [0201]  186.28,16.51 0 top
R26427  10K  [0201]  186.28,17.12 0 top
R26428  10K  [0201]  186.28,17.73 0 top
R26429  10K  [0201]  186.28,18.34 0 top
R26430  10K  [0201]  186.28,18.95 0 top
R26431  10K  [0201]  186.28,19.56 0 top
R26432  10K  [0201]  186.28,20.17 0 top
R26433  10K  [0201]  186.28,20.78 0 top
R26434  10K  [0201]  186.28,21.39 0 top
R26435  10K  [0201]  186.28,22 0 top
R26436  10K  [0201]  186.28,22.61 0 top
R26437  10K  [0201]  186.28,23.22 0 top
R26438  10K  [0201]  186.28,23.83 0 top
R26439  10K  [0201]  186.28,24.43 0 top
R26440  10K  [0201]  186.28,25.04 0 top
R26441  10K  [0201]  186.28,25.65 0 top
R26442  10K  [0201]  186.28,26.26 0 top
R26443  10K  [0201]  186.28,26.87 0 top
R26444  10K  [0201]  186.28,27.48 0 top
R26445  10K  [0201]  186.28,28.09 0 top
R26446  10K  [0201]  186.28,28.7 0 top
R26447  10K  [0201]  186.28,29.31 0 top
R26448  10K  [0201]  186.28,29.92 0 top
R26449  10K  [0201]  186.28,30.53 0 top
R26450  10K  [0201]  186.28,31.14 0 top
R26451  10K  [0201]  186.28,31.75 0 top
R26452  10K  [0201]  186.28,32.36 0 top
R26453  10K  [0201]  186.28,32.97 0 top
R26454  10K  [0201]  186.28,33.58 0 top
R26455  10K  [0201]  186.28,34.19 0 top
R26456  10K  [0201]  186.28,34.8 0 top
R26457  10K  [0201]  186.28,35.41 0 top
R26458  10K  [0201]  186.28,36.02 0 top
R26459  10K  [0201]  186.28,36.63 0 top
R26460  10K  [0201]  186.28,37.24 0 top
R26461  10K  [0201]  186.28,37.85 0 top
R26462  10K  [0201]  186.28,38.46 0 top
R26463  10K  [0201]  186.28,39.07 0 top
R26464  10K  [0201]  186.28,39.67 0 top
R26465  10K  [0201]  186.28,40.28 0 top
R26466  10K  [0201]  186.28,40.89 0 top
R26467  10K  [0201]  186.28,41.5 0 top
R26468  10K  [0201]  186.28,42.11 0 top
R26469  10K  [0201]  186.28,42.72 0 top
R26470  10K  [0201]  186.28,43.33 0 top
R26471  10K  [0201]  186.28,43.94 0 top
R26472  10K  [0201]  186.28,44.55 0 top
R26473  10K  [0201]  186.28,45.16 0 top
R26474  10K  [0201]  186.28,45.77 0 top
R26475  10K  [0201]  186.28,46.38 0 top
R26476  10K  [0201]  186.28,46.99 0 top
R26477  10K  [0201]  186.28,47.6 0 top
R26478  10K  [0201]  186.28,48.21 0 top
R26479  10K  [0201]  186.28,48.82 0 top
R26480  10K  [0201]  186.28,49.43 0 top
R26481  10K  [0201]  186.28,50.04 0 top
R26482  10K  [0201]  186.28,50.65 0 top
R26483  10K  [0201]  186.28,51.26 0 top
R26484  10K  [0201]  186.28,51.87 0 top
R26485  10K  [0201]  186.28,52.48 0 top
R26486  10K  [0201]  186.28,53.09 0 top
R26487  10K  [0201]  186.28,53.7 0 top
R26488  10K  [0201]  186.28,54.31 0 top
R26489  10K  [0201]  186.28,54.91 0 top
R26490  10K  [0201]  186.28,55.52 0 top
R26491  10K  [0201]  186.28,56.13 0 top
R26492  10K  [0201]  186.28,56.74 0 top
R26493  10K  [0201]  186.28,57.35 0 top
R26494  10K  [0201]  186.28,57.96 0 top
R26495  10K  [0201]  186.28,58.57 0 top
R26496  10K  [0201]  186.28,59.18 0 top
R26497  10K  [0201]  186.28,59.79 0 top
R26498  10K  [0201]  186.28,60.4 0 top
R26499  10K  [0201]  186.28,61.01 0 top
R26500  10K  [0201]  186.28,61.62 0 top
R26501  10K  [0201]  186.28,62.23 0 top
R26502  10K  [0201]  186.28,62.84 0 top
R26503  10K  [0201]  186.28,63.45 0 top
R26504  10K  [0201]  186.28,64.06 0 top
R26505  10K  [0201]  186.28,64.67 0 top
R26506  10K  [0201]  186.28,65.28 0 top
R26507  10K  [0201]  186.28,65.89 0 top
R26508  10K  [0201]  186.28,66.5 0 top
R26509  10K  [0201]  186.28,67.11 0 top
R26510  10K  [0201]  186.28,67.72 0 top
R26511  10K  [0201]  186.28,68.33 0 top
R26512  10K  [0201]  186.28,68.94 0 top
R26513  10K  [0201]  186.28,69.55 0 top
R26514  10K  [0201]  186.28,70.15 0 top
R26515  10K  [0201]  186.28,70.76 0 top
R26516  10K  [0201]  186.28,71.37 0 top
R26517  10K  [0201]  186.28,71.98 0 top
R26518  10K  [0201]  186.28,72.59 0 top
R26519  10K  [0201]  186.28,73.2 0 top
R26520  10K  [0201]  186.28,73.81 0 top
R26521  10K  [0201]  186.28,74.42 0 top
R26522  10K  [0201]  186.28,75.03 0 top
R26523  10K  [0201]  186.28,75.64 0 top
R26524  10K  [0201]  186.28,76.25 0 top
R26525  10K  [0201]  186.28,76.86 0 top
R26526  10K  [0201]  186.28,77.47 0 top
R26527  10K  [0201]  186.28,78.08 0 top
R26528  10K  [0201]  186.28,78.69 0 top
R26529  10K  [0201]  186.28,79.3 0 top
R26530  10K  [0201]  186.28,79.91 0 top
R26531  10K  [0201]  186.28,80.52 0 top
R26532  10K  [0201]  186.28,81.13 0 top
R26533  10K  [0201]  186.28,81.74 0 top
R26534  10K  [0201]  186.28,82.35 0 top
R26535  10K  [0201]  186.28,82.96 0 top
R26536  10K  [0201]  186.28,83.57 0 top
R26537  10K  [0201]  186.28,84.18 0 top
R26538  10K  [0201]  186.28,84.79 0 top
R26539  10K  [0201]  186.28,85.39 0 top
R26540  10K  [0201]  186.28,86 0 top
R26541  10K  [0201]  186.28,86.61 0 top
R26542  10K  [0201]  186.28,87.22 0 top
R26543  10K  [0201]  186.28,87.83 0 top
R26544  10K  [0201]  186.28,88.44 0 top
R26545  10K  [0201]  186.28,89.05 0 top
R26546  10K  [0201]  186.28,89.66 0 top
R26547  10K  [0201]  186.28,90.27 0 top
R26548  10K  [0201]  186.28,90.88 0 top
R26549  10K  [0201]  186.28,91.49 0 top
R26550  10K  [0201]  186.28,92.1 0 top
R26551  10K  [0201]  186.28,92.71 0 top
R26552  10K  [0201]  186.28,93.32 0 top
R26553  10K  [0201]  186.28,93.93 0 top
R26554  10K  [0201]  186.28,94.54 0 top
R26555  10K  [0201]  186.28,95.15 0 top
R26556  10K  [0201]  186.28,95.76 0 top
R26557  10K  [0201]  186.28,96.37 0 top
R26558  10K  [0201]  186.28,96.98 0 top
R26559  10K  [0201]  186.28,97.59 0 top
R26560  10K  [0201]  186.28,98.2 0 top
R26561  10K  [0201]  186.28,98.81 0 top
R26562  10K  [0201]  186.28,99.42 0 top
R26563  10K  [0201]  186.28,100.03 0 top
R26564  10K  [0201]  186.28,100.63 0 top
R26565  10K  [0201]  186.28,101.24 0 top
R26566  10K  [0201]  186.28,101.85 0 top
R26567  10K  [0201]  186.28,102.46 0 top
R26568  10K  [0201]  186.28,103.07 0 top
R26569  10K  [0201]  186.28,103.68 0 top
R26570  10K  [0201]  186.28,104.29 0 top
R26571  10K  [0201]  186.28,104.9 0 top
R26572  10K  [0201]  186.28,105.51 0 top
R26573  10K  [0201]  186.28,106.12 0 top
R26574  10K  [0201]  186.28,106.73 0 top
R26575  10K  [0201]  186.28,107.34 0 top
R26576  10K  [0201]  186.28,107.95 0 top
R26577  10K  [0201]  186.28,108.56 0 top
R26578  10K  [0201]  186.28,109.17 0 top
R26579  10K  [0201]  186.28,109.78 0 top
R26580  10K  [0201]  186.28,110.39 0 top
R26581  10K  [0201]  186.28,111 0 top
R26582  10K  [0201]  186.28,111.61 0 top
R26583  10K  [0201]  186.28,112.22 0 top
R26584  10K  [0201]  186.28,112.83 0 top
R26585  10K  [0201]  186.28,113.44 0 top
R26586  10K  [0201]  186.28,114.05 0 top
R26587  10K  [0201]  186.28,114.66 0 top
R26588  10K  [0201]  186.28,115.27 0 top
R26589  10K  [0201]  186.28,115.87 0 top
R26590  10K  [0201]  186.28,116.48 0 top
R26591  10K  [0201]  186.28,117.09 0 top
R26592  10K  [0201]  186.28,117.7 0 top
R26593  10K  [0201]  186.28,118.31 0 top
R26594  10K  [0201]  186.28,118.92 0 top
R26595  10K  [0201]  186.28,119.53 0 top
R26596  10K  [0201]  186.28,120.14 0 top
R26597  10K  [0201]  186.28,120.75 0 top
R26598  10K  [0201]  186.28,121.36 0 top
R26599  10K  [0201]  186.28,121.97 0 top
R26600  10K  [0201]  186.28,122.58 0 top
R26601  10K  [0201]  187.5,1.27 0 top
R26602  10K  [0201]  187.5,1.88 0 top
R26603  10K  [0201]  187.5,2.49 0 top
R26604  10K  [0201]  187.5,3.1 0 top
R26605  10K  [0201]  187.5,3.71 0 top
R26606  10K  [0201]  187.5,4.32 0 top
R26607  10K  [0201]  187.5,4.93 0 top
R26608  10K  [0201]  187.5,5.54 0 top
R26609  10K  [0201]  187.5,6.15 0 top
R26610  10K  [0201]  187.5,6.76 0 top
R26611  10K  [0201]  187.5,7.37 0 top
R26612  10K  [0201]  187.5,7.98 0 top
R26613  10K  [0201]  187.5,8.59 0 top
R26614  10K  [0201]  187.5,9.19 0 top
R26615  10K  [0201]  187.5,9.8 0 top
R26616  10K  [0201]  187.5,10.41 0 top
R26617  10K  [0201]  187.5,11.02 0 top
R26618  10K  [0201]  187.5,11.63 0 top
R26619  10K  [0201]  187.5,12.24 0 top
R26620  10K  [0201]  187.5,12.85 0 top
R26621  10K  [0201]  187.5,13.46 0 top
R26622  10K  [0201]  187.5,14.07 0 top
R26623  10K  [0201]  187.5,14.68 0 top
R26624  10K  [0201]  187.5,15.29 0 top
R26625  10K  [0201]  187.5,15.9 0 top
R26626  10K  [0201]  187.5,16.51 0 top
R26627  10K  [0201]  187.5,17.12 0 top
R26628  10K  [0201]  187.5,17.73 0 top
R26629  10K  [0201]  187.5,18.34 0 top
R26630  10K  [0201]  187.5,18.95 0 top
R26631  10K  [0201]  187.5,19.56 0 top
R26632  10K  [0201]  187.5,20.17 0 top
R26633  10K  [0201]  187.5,20.78 0 top
R26634  10K  [0201]  187.5,21.39 0 top
R26635  10K  [0201]  187.5,22 0 top
R26636  10K  [0201]  187.5,22.61 0 top
R26637  10K  [0201]  187.5,23.22 0 top
R26638  10K  [0201]  187.5,23.83 0 top
R26639  10K  [0201]  187.5,24.43 0 top
R26640  10K  [0201]  187.5,25.04 0 top
R26641  10K  [0201]  187.5,25.65 0 top
R26642  10K  [0201]  187.5,26.26 0 top
R26643  10K  [0201]  187.5,26.87 0 top
R26644  10K  [0201]  187.5,27.48 0 top
R26645  10K  [0201]  187.5,28.09 0 top
R26646  10K  [0201]  187.5,28.7 0 top
R26647  10K  [0201]  187.5,29.31 0 top
R26648  10K  [0201]  187.5,29.92 0 top
R26649  10K  [0201]  187.5,30.53 0 top
R26650  10K  [0201]  187.5,31.14 0 top
R26651  10K  [0201]  187.5,31.75 0 top
R26652  10K  [0201]  187.5,32.36 0 top
R26653  10K  [0201]  187.5,32.97 0 top
R26654  10K  [0201]  187.5,33.58 0 top
R26655  10K  [0201]  187.5,34.19 0 top
R26656  10K  [0201]  187.5,34.8 0 top
R26657  10K  [0201]  187.5,35.41 0 top
R26658  10K  [0201]  187.5,36.02 0 top
R26659  10K  [0201]  187.5,36.63 0 top
R26660  10K  [0201]  187.5,37.24 0 top
R26661  10K  [0201]  187.5,37.85 0 top
R26662  10K  [0201]  187.5,38.46 0 top
R26663  10K  [0201]  187.5,39.07 0 top
R26664  10K  [0201]  187.5,39.67 0 top
R26665  10K  [0201]  187.5,40.28 0 top
R26666  10K  [0201]  187.5,40.89 0 top
R26667  10K  [0201]  187.5,41.5 0 top
R26668  10K  [0201]  187.5,42.11 0 top
R26669  10K  [0201]  187.5,42.72 0 top
R26670  10K  [0201]  187.5,43.33 0 top
R26671  10K  [0201]  187.5,43.94 0 top
R26672  10K  [0201]  187.5,44.55 0 top
R26673  10K  [0201]  187.5,45.16 0 top
R26674  10K  [0201]  187.5,45.77 0 top
R26675  10K  [0201]  187.5,46.38 0 top
R26676  10K  [0201]  187.5,46.99 0 top
R26677  10K  [0201]  187.5,47.6 0 top
R26678  10K  [0201]  187.5,48.21 0 top
R26679  10K  [0201]  187.5,48.82 0 top
R26680  10K  [0201]  187.5,49.43 0 top
R26681  10K  [0201]  187.5,50.04 0 top
R26682  10K  [0201]  187.5,50.65 0 top
R26683  10K  [0201]  187.5,51.26 0 top
R26684  10K  [0201]  187.5,51.87 0 top
R26685  10K  [0201]  187.5,52.48 0 top
R26686  10K  [0201]  187.5,53.09 0 top
R26687  10K  [0201]  187.5,53.7 0 top
R26688  10K  [0201]  187.5,54.31 0 top
R26689  10K  [0201]  187.5,54.91 0 top
R26690  10K  [0201]  187.5,55.52 0 top
R26691  10K  [0201]  187.5,56.13 0 top
R26692  10K  [0201]  187.5,56.74 0 top
R26693  10K  [0201]  187.5,57.35 0 top
R26694  10K  [0201]  187.5,57.96 0 top
R26695  10K  [0201]  187.5,58.57 0 top
R26696  10K  [0201]  187.5,59.18 0 top
R26697  10K  [0201]  187.5,59.79 0 top
R26698  10K  [0201]  187.5,60.4 0 top
R26699  10K  [0201]  187.5,61.01 0 top
R26700  10K  [0201]  187.5,61.62 0 top
R26701  10K  [0201]  187.5,62.23 0 top
R26702  10K  [0201]  187.5,62.84 0 top
R26703  10K  [0201]  187.5,63.45 0 top
R26704  10K  [0201]  187.5,64.06 0 top
R26705  10K  [0201]  187.5,64.67 0 top
R26706  10K  [0201]  187.5,65.28 0 top
R26707  10K  [0201]  187.5,65.89 0 top
R26708  10K  [0201]  187.5,66.5 0 top
R26709  10K  [0201]  187.5,67.11 0 top
R26710  10K  [0201]  187.5,67.72 0 top
R26711  10K  [0201]  187.5,68.33 0 top
R26712  10K  [0201]  187.5,68.94 0 top
R26713  10K  [0201]  187.5,69.55 0 top
R26714  10K  [0201]  187.5,70.15 0 top
R26715  10K  [0201]  187.5,70.76 0 top
R26716  10K  [0201]  187.5,71.37 0 top
R26717  10K  [0201]  187.5,71.98 0 top
R26718  10K  [0201]  187.5,72.59 0 top
R26719  10K  [0201]  187.5,73.2 0 top
R26720  10K  [0201]  187.5,73.81 0 top